# EasyEDA Pro project F4_Camera.eprj

# Schematic Schematic1
Board Name: Board1; Create Date: 2025-01-09
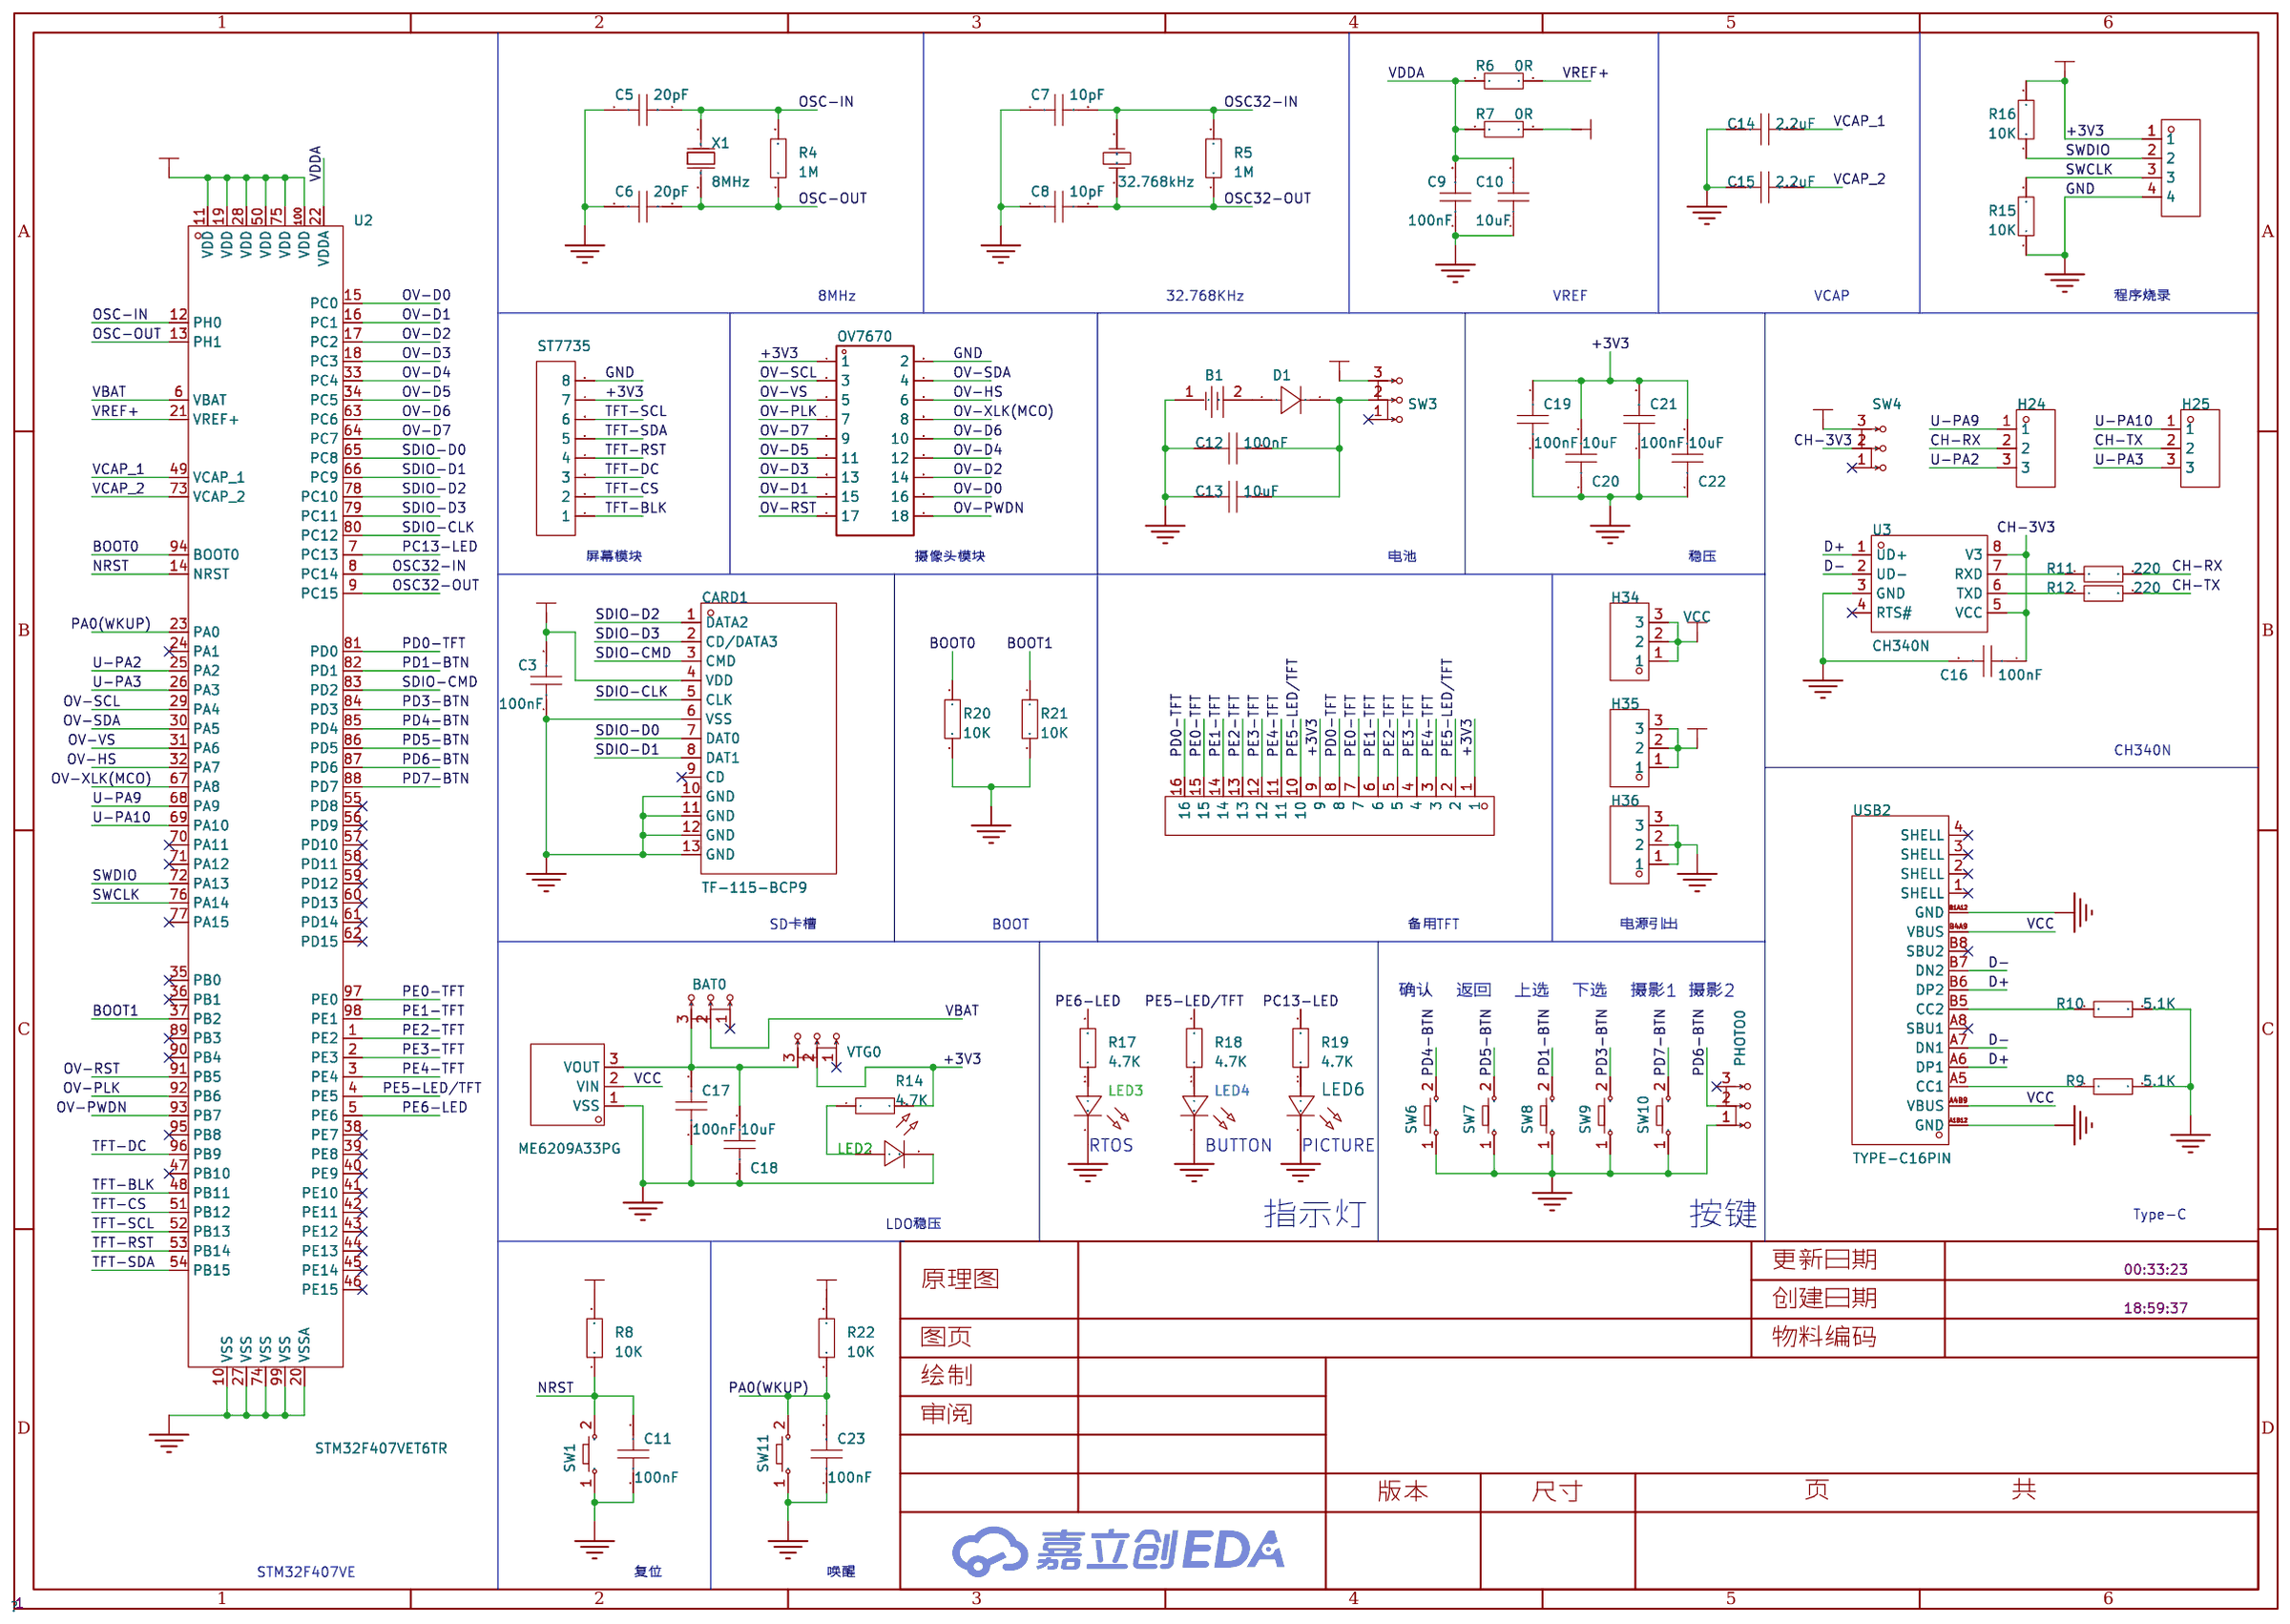
[diagram p0: schematic sheet]

## Parts
B1  BS-02-A1AJ010  [BAT-TH_BS-02-A1AJ010]
BAT0  SS-12D01-G5  [SW-TH_SS-12D01-GX]
C3  100nF  [C0805]
C5  20pF  [C0805]
C6  20pF  [C0805]
C7  10pF  [C0805]
C8  10pF  [C0805]
C9  100nF  [C0805]
C10  10uF  [C0805]
C11  100nF  [C0805]
C12  100nF  [C0805]
C13  10uF  [C0805]
C14  2.2uF  [C0805]
C15  2.2uF  [C0805]
C16  100nF  [C0805]
C17  100nF  [C0805]
C18  10uF  [C0805]
C19  100nF  [C0805]
C20  10uF  [C0805]
C21  100nF  [C0805]
C22  10uF  [C0805]
C23  100nF  [C0805]
CARD1  TF-115-BCP9  [TF-SMD_TF-115-BCP9]
D1  -  [SMA_1N4007]
H24  -  [HDR-TH_3P-P2.54-V-M]
H25  -  [HDR-TH_3P-P2.54-V-M]
H34  -  [HDR-TH_3P-P2.54-V-M]
H35  -  [HDR-TH_3P-P2.54-V-M]
H36  -  [HDR-TH_3P-P2.54-V-M]
H37  -  [HDR-TH_4P-P2.54-V-M]
H38  -  [HDR-TH_16P-P2.54-V-F]
LED2  -  [LED_0805]
LED3  -  [LED_0805]
LED4  -  [LED_0805]
LED6  -  [LED_0805]
OV7670  -  [HDR-TH_18P-P2.54-V-F-R2-C9-S2.54-1]
PHOTO0  SS-12D01-G5  [SW-TH_SS-12D01-GX]
R4  1M  [R0805]
R5  1M  [R0805]
R6  0R  [R0805]
R7  0R  [R0805]
R8  10K  [R0805]
R9  5.1K  [R0805]
R10  5.1K  [R0805]
R11  220  [R0805]
R12  220  [R0805]
R14  4.7K  [R0805]
R15  10K  [R0805]
R16  10K  [R0805]
R17  4.7K  [R0805]
R18  4.7K  [R0805]
R19  4.7K  [R0805]
R20  10K  [R0805]
R21  10K  [R0805]
R22  10K  [R0805]
ST7735  -  [HDR-TH_8P-P2.54-V-F-1]
SW1  -  [Key_SMD_3x4x2]
SW3  SS-12D01-G5  [SW-TH_SS-12D01-GX]
SW4  SS-12D01-G5  [SW-TH_SS-12D01-GX]
SW6  -  [Key_SMD_3x4x2]
SW7  -  [Key_SMD_3x4x2]
SW8  -  [Key_SMD_3x4x2]
SW9  -  [Key_SMD_3x4x2]
SW10  -  [Key_SMD_3x4x2]
SW11  -  [Key_SMD_3x4x2]
U2  STM32F407VET6TR  [LQFP-100_L14.0-W14.0-P0.50-LS16.0-BL]
U3  CH340N  [SOP-8_L4.9-W3.9-P1.27-LS6.0-BL]
U4  ME6209A33PG  [SOT-89-3_L4.5-W2.5-P1.50-LS4.2-BR]
USB2  TYPE-C16PIN  [USB-C-SMD_TYPE-C16PIN]
VTG0  SS-12D01-G5  [SW-TH_SS-12D01-GX]
X1  8MHz  [CRYSTAL-SMD_L11.5-W4.8-LS12.7]
X3  32.768kHz  [OSC-TH_BD3.1-P0.8-D0.3]

## Library data of the parts
B1 = BS-02-A1AJ010: LCSC Part Name: 电池底座 适用电池:CR2032; Supplier Part: C5239862; Manufacturer: MYOUNG(美阳); Supplier Footprint: 插件; JLCPCB Part Class: 扩展库; Datasheet: https://atta.szlcsc.com/upload/public/pdf/source/20221102/8F00F2B23A2A3C447A59C327BBA6C743.pdf; Supplier: LCSC; Connector Type: 电池底座; Battery Type: CR2032; Contact Material: 磷青铜; Contact Plating: 镍; Operating Temperature Range: -25℃~+85℃
BAT0 PHOTO0 SW3 SW4 VTG0 = SS-12D01-G5: LCSC Part Name: 8.8*3.9*4.0mm/柄长5MM,1P2T; Supplier Part: C698218; Manufacturer: USAKRO(美韩); Supplier Footprint: 插件; JLCPCB Part Class: 扩展库; Datasheet: https://atta.szlcsc.com/upload/public/pdf/source/20200708/C698218_847C5BF192AAD1D7BD79B672259211AF.pdf; Supplier: LCSC
C3 C9-C23 = CAP_0805: Supplier Footprint: 0805
C5-C8 = CAP_0603: Supplier Footprint: 0603; Check: true
CARD1 = TF-115-BCP9: 卡连接方式:自弹式;卡类型:MicroSD卡(TF卡);连接器类型:卡座;本体最大高度:1.8mm;工作温度范围:-25℃~+85℃;; LCSC Part Name: 自弹式 MicroSD卡(TF卡) 卡座; Supplier Part: C720505; Manufacturer: XUNPU(讯普); Supplier Footprint: SMD; JLCPCB Part Class: 扩展库; Datasheet: https://atta.szlcsc.com/upload/public/pdf/source/20210906/DBEC8F03AA1503572333C7CF4A76D0AD.pdf; Supplier: LCSC; Card Connection Mode: 自弹式; Card Type: MicroSD卡(TF卡); Connector Type: 卡座; Maximum Body Height: 1.8mm; Operating Temperature Range: -25℃~+85℃
D1 = D_1N4007: Supplier Footprint: SMA
H24 H25 H34-H36 = HDR-M_2.54_1x3P: Supplier Part: C2937625; Supplier Footprint: 插件
H37 = HDR-M_2.54_1x4P: Supplier Part: C492403; Supplier Footprint: 插件
H38 = HDR-F_2.54_1x16P: Supplier Part: C124409; Supplier Footprint: 插件
LED2 LED3 = LED_0805-G: Supplier Footprint: 0805
LED4 = LED_0805-B: Supplier Footprint: 0805
LED6 = LED_0805-R: Supplier Footprint: 0805
OV7670 = HDR-F_2.54_2x9: Supplier Part: C132125; Supplier Footprint: 插件
R4 R5 R15 R16 = Res_0603: Supplier Footprint: 0603; Check: true
R6-R12 R14 R17-R22 = Res_0805: Supplier Footprint: 0805
ST7735 = HDR-F_2.54_1x8P: Supplier Part: C27438; Supplier Footprint: 插件
SW1 SW6-SW11 = Key_SMD_3x4x2: Supplier Footprint: SMD
U2 = STM32F407VET6TR: LCSC Part Name: 带DSP和FPU的高性能基础系列ARM Cortex-M4 MCU，具有512 KB Flash、168 MHz CPU、ART加速器、以太网和FSMC; Supplier Part: C5269943; Manufacturer: ST(意法半导体); Supplier Footprint: LQFP-100(14x14); JLCPCB Part Class: 扩展库; Datasheet: https://atta.szlcsc.com/upload/public/pdf/source/20201130/C919362_39400D478C258148B3DF984CE4A4041A.pdf; Supplier: LCSC; CPU Core: ARM-M4; CPU Maximum Speed: 168MHz; Number of I/O: 82; ADC (Bit): 12bit; DAC (Bit): 12bit; Low Voltage Detection Threshold: 1.8V~3.6V
U3 = CH340N: LCSC Part Name: USB转串口芯片CH340; Supplier Part: C2977777; Manufacturer: WCH(南京沁恒); Supplier Footprint: SOP-8; JLCPCB Part Class: 扩展库; Datasheet: https://atta.szlcsc.com/upload/public/pdf/source/20240313/115CDE92081B1D6CB446704AD5D0F5F2.pdf; Supplier: LCSC; Applications Function: USB转串口; Protocol: USB 2.0; Number of Channels: 1; Supply Voltage: 3.3V；5V; Data Rate: 2Mbps; Operating Temperature: -20℃~+70℃
U4 = ME6209A33PG: LCSC Part Name: 输入18V 输出3.3V 250mA; Supplier Part: C80222; Manufacturer: MICRONE(南京微盟); Supplier Footprint: SOT-89-3; JLCPCB Part Class: 扩展库; Datasheet: https://atta.szlcsc.com/upload/public/pdf/source/20160903/1472896599532.pdf; Supplier: LCSC; Output Type: 固定; Maximum Input Voltage: 18V; Output Voltage: 3.3V; MAX Output Current: 250mA; Dropout Voltage: 80mV@(40mA); Output Polarity: 正极; Number of Outputs: 1
USB2 = TYPE-C16PIN: 连接器类型:Type-C;标准:USB 3.1;公母:母;安装方式:卧贴;触点数量:16P;端口数量:1;额定电流 - 电源:3A;工作温度范围:-40℃~+85℃;; LCSC Part Name: Type-C 母 卧贴; Supplier Part: C393939; Manufacturer: SHOU HAN(首韩); Supplier Footprint: SMD; JLCPCB Part Class: 扩展库; Datasheet: https://atta.szlcsc.com/upload/public/pdf/source/20190521/C393939_7B9043D4CF1026AF443AB60D91FBCD5C.pdf; Supplier: LCSC; Connector Type: Type-C; Standard: USB 3.1; Gender: 母; Mounting Style: 卧贴; Number of Contacts: 16P; Number of Ports: 1; Current Rating - Power (Max): 3A; Operating Temperature Range: -40℃~+85℃; Rated Voltage (Max): 30V; Connect-Disconnect Life: 1万次; Core Colour: 黑色; Check: true
X1 = X49SM8MSD2SC: 晶振类型:贴片晶振;频率:8MHz;常温频差:±20ppm;外接负载电容:20pF;频率稳定度(全温):±30ppm;; LCSC Part Name: 8MHz ±20ppm 20pF; Supplier Part: C12674; Manufacturer: YXC(扬兴晶振); Supplier Footprint: HC-49S-SMD; JLCPCB Part Class: 基础库; Datasheet: https://atta.szlcsc.com/upload/public/pdf/source/20240329/3EBF42EBCAB50CA65B6FA9D7CFA1955A.pdf; Supplier: LCSC; Crystal Type: 贴片晶振; Normal temperature Frequency Tolerance: ±20ppm; External load capacitor: 20pF; Frequency Stability(Full temperature range): ±30ppm; Operating Temperature: -20℃~+70℃; Check: true
X3 = X308032768KGB2SC: 晶振类型:直插晶振;频率:32.768kHz;常温频差:±10ppm;外接负载电容:12.5pF;频率稳定度(全温):-;; LCSC Part Name: 32.768kHz ±10ppm 12.5pF YT-38; Supplier Part: C52082; Manufacturer: YXC(扬兴晶振); Supplier Footprint: DT-38; JLCPCB Part Class: 扩展库; Datasheet: https://atta.szlcsc.com/upload/public/pdf/source/20240329/231E1A1EB7C875CD193DBE6664A3DE3A.pdf; Supplier: LCSC; Crystal Type: 直插晶振; Normal temperature Frequency Tolerance: ±10ppm; External load capacitor: 12.5pF; Operating Temperature: -20℃~+70℃

## Nets
+3V3: C3.2 C19.2 C20.2 C21.2 C22.2 CARD1.4(VDD) H35.1 H35.2 H35.3 H37.1 H38.1 H38.9 OV7670.1 R7.2 R8.2 R14.2 R16.2 R22.2 ST7735.7 SW4.3 U2.11(VDD) U2.19(VDD) U2.28(VDD) U2.50(VDD) U2.75(VDD) U2.100(VDD) VTG0.2
GND: B1.1 C3.1 C5.1 C6.1 C7.1 C8.1 C9.1 C10.1 C11.1 C12.1 C13.1 C14.2 C15.2 C16.2 C17.1 C18.1 C19.1 C20.1 C21.1 C22.1 C23.1 CARD1.6(VSS) CARD1.10(GND) CARD1.11(GND) CARD1.12(GND) CARD1.13(GND) H36.1 H36.2 H36.3 H37.4 LED2.1(C) LED3.1(C) LED4.1(C) LED6.1(C) OV7670.2 PHOTO0.1 R9.2 R10.2 R15.1 R20.2 R21.2 ST7735.8 SW1.1 SW6.1 SW7.1 SW8.1 SW9.1 SW10.1 SW11.1 U2.10(VSS) U2.20(VSSA) U2.27(VSS) U2.74(VSS) U2.99(VSS) U3.3(GND) U4.1(VSS) USB2.A1B12(GND) USB2.B1A12(GND)
VBAT: BAT0.2 U2.6(VBAT)
VCC: H34.1 H34.2 H34.3 SW3.3 U4.2(VIN) USB2.A4B9(VBUS) USB2.B4A9(VBUS)
VDDA: C9.2 C10.2 R6.1 R7.1 U2.22(VDDA)
BOOT0: R20.1 U2.94(BOOT0)
BOOT1: R21.1 U2.37(PB2)
CH-3V3: C16.1 SW4.2 U3.5(VCC) U3.8(V3)
CH-RX: H24.2 R11.2
CH-TX: H25.2 R12.2
D+: U3.1(UD+) USB2.A6(DP1) USB2.B6(DP2)
D-: U3.2(UD-) USB2.A7(DN1) USB2.B7(DN2)
NRST: C11.2 R8.1 SW1.2 U2.14(NRST)
OSC32-IN: C7.2 R5.2 U2.8(PC14) X3.1(OSC1)
OSC32-OUT: C8.2 R5.1 U2.9(PC15) X3.2(OSC2)
OSC-IN: C5.2 R4.2 U2.12(PH0) X1.1(OSC1)
OSC-OUT: C6.2 R4.1 U2.13(PH1) X1.2(OSC2)
OV-D0: OV7670.16 U2.15(PC0)
OV-D1: OV7670.15 U2.16(PC1)
OV-D2: OV7670.14 U2.17(PC2)
OV-D3: OV7670.13 U2.18(PC3)
OV-D4: OV7670.12 U2.33(PC4)
OV-D5: OV7670.11 U2.34(PC5)
OV-D6: OV7670.10 U2.63(PC6)
OV-D7: OV7670.9 U2.64(PC7)
OV-HS: OV7670.6 U2.32(PA7)
OV-PLK: OV7670.7 U2.92(PB6)
OV-PWDN: OV7670.18 U2.93(PB7)
OV-RST: OV7670.17 U2.91(PB5)
OV-SCL: OV7670.3 U2.29(PA4)
OV-SDA: OV7670.4 U2.30(PA5)
OV-VS: OV7670.5 U2.31(PA6)
OV-XLK(MCO): OV7670.8 U2.67(PA8)
PA0(WKUP): C23.2 R22.1 SW11.2 U2.23(PA0)
PC13-LED: R19.2 U2.7(PC13)
PD0-TFT: H38.8 H38.16 U2.81(PD0)
PD1-BTN: SW8.2 U2.82(PD1)
PD3-BTN: SW9.2 U2.84(PD3)
PD4-BTN: SW6.2 U2.85(PD4)
PD5-BTN: SW7.2 U2.86(PD5)
PD6-BTN: PHOTO0.2 U2.87(PD6)
PD7-BTN: SW10.2 U2.88(PD7)
PE0-TFT: H38.7 H38.15 U2.97(PE0)
PE1-TFT: H38.6 H38.14 U2.98(PE1)
PE2-TFT: H38.5 H38.13 U2.1(PE2)
PE3-TFT: H38.4 H38.12 U2.2(PE3)
PE4-TFT: H38.3 H38.11 U2.3(PE4)
PE5-LED/TFT: H38.2 H38.10 R18.2 U2.4(PE5)
PE6-LED: R17.2 U2.5(PE6)
SDIO-CLK: CARD1.5(CLK) U2.80(PC12)
SDIO-CMD: CARD1.3(CMD) U2.83(PD2)
SDIO-D0: CARD1.7(DAT0) U2.65(PC8)
SDIO-D1: CARD1.8(DAT1) U2.66(PC9)
SDIO-D2: CARD1.1(DATA2) U2.78(PC10)
SDIO-D3: CARD1.2(CD/DATA3) U2.79(PC11)
SWCLK: H37.3 R15.2 U2.76(PA14)
SWDIO: H37.2 R16.1 U2.72(PA13)
TFT-BLK: ST7735.1 U2.48(PB11)
TFT-CS: ST7735.2 U2.51(PB12)
TFT-DC: ST7735.3 U2.96(PB9)
TFT-RST: ST7735.4 U2.53(PB14)
TFT-SCL: ST7735.6 U2.52(PB13)
TFT-SDA: ST7735.5 U2.54(PB15)
U-PA2: H24.3 U2.25(PA2)
U-PA3: H25.3 U2.26(PA3)
U-PA9: H24.1 U2.68(PA9)
U-PA10: H25.1 U2.69(PA10)
VCAP_1: C14.1 U2.49(VCAP_1)
VCAP_2: C15.1 U2.73(VCAP_2)
VREF+: R6.2 U2.21(VREF+)
$1N4149: B1.2 D1.2(A)
$1N4157: C12.2 C13.2 D1.1(K) SW3.2
$1N4377: R9.1 USB2.A5(CC1)
$1N4405: R10.1 USB2.B5(CC2)
$1N4661: R11.1 U3.7(RXD)
$1N4738: R12.1 U3.6(TXD)
$1N5807: LED2.2(A) R14.1
$1N5874: BAT0.3 C17.2 C18.2 U4.3(VOUT) VTG0.3
$1N6809: LED3.2(A) R17.1
$1N6943: LED4.2(A) R18.1
$1N7074: LED6.2(A) R19.1

Not connected (* = marked no-connect by the designer): BAT0 1*; CARD1 9(CD)*; PHOTO0 3*; SW3 1*; SW4 1*; U2 24(PA1)* 35(PB0)* 36(PB1)* 38(PE7)* 39(PE8)* 40(PE9)* 41(PE10)* 42(PE11)* 43(PE12)* 44(PE13)* 45(PE14)* 46(PE15)* 47(PB10)* 55(PD8)* 56(PD9)* 57(PD10)* 58(PD11)* 59(PD12)* 60(PD13)* 61(PD14)* 62(PD15)* 70(PA11)* 71(PA12)* 77(PA15)* 89(PB3)* 90(PB4)* 95(PB8)*; U3 4(RTS#)*; USB2 1(SHELL)* 2(SHELL)* 3(SHELL)* 4(SHELL)* A8(SBU1)* B8(SBU2)*; VTG0 1*

## Notes on the sheet
- 8MHz
- 32.768KHz
- VREF
- VCAP
- 程序烧录
- 屏幕模块
- 摄像头模块
- 电池
- 稳压
- CH340N
- SD卡槽
- BOOT
- 备用TFT
- 电源引出
- 确认
- 返回
- 上选
- 下选
- 摄影1
- 摄影2
- RTOS
- BUTTON
- PICTURE
- LDO稳压
- 指示灯
- 按键
- Type-C
- STM32F407VE
- 复位
- 唤醒

# Board PCB1
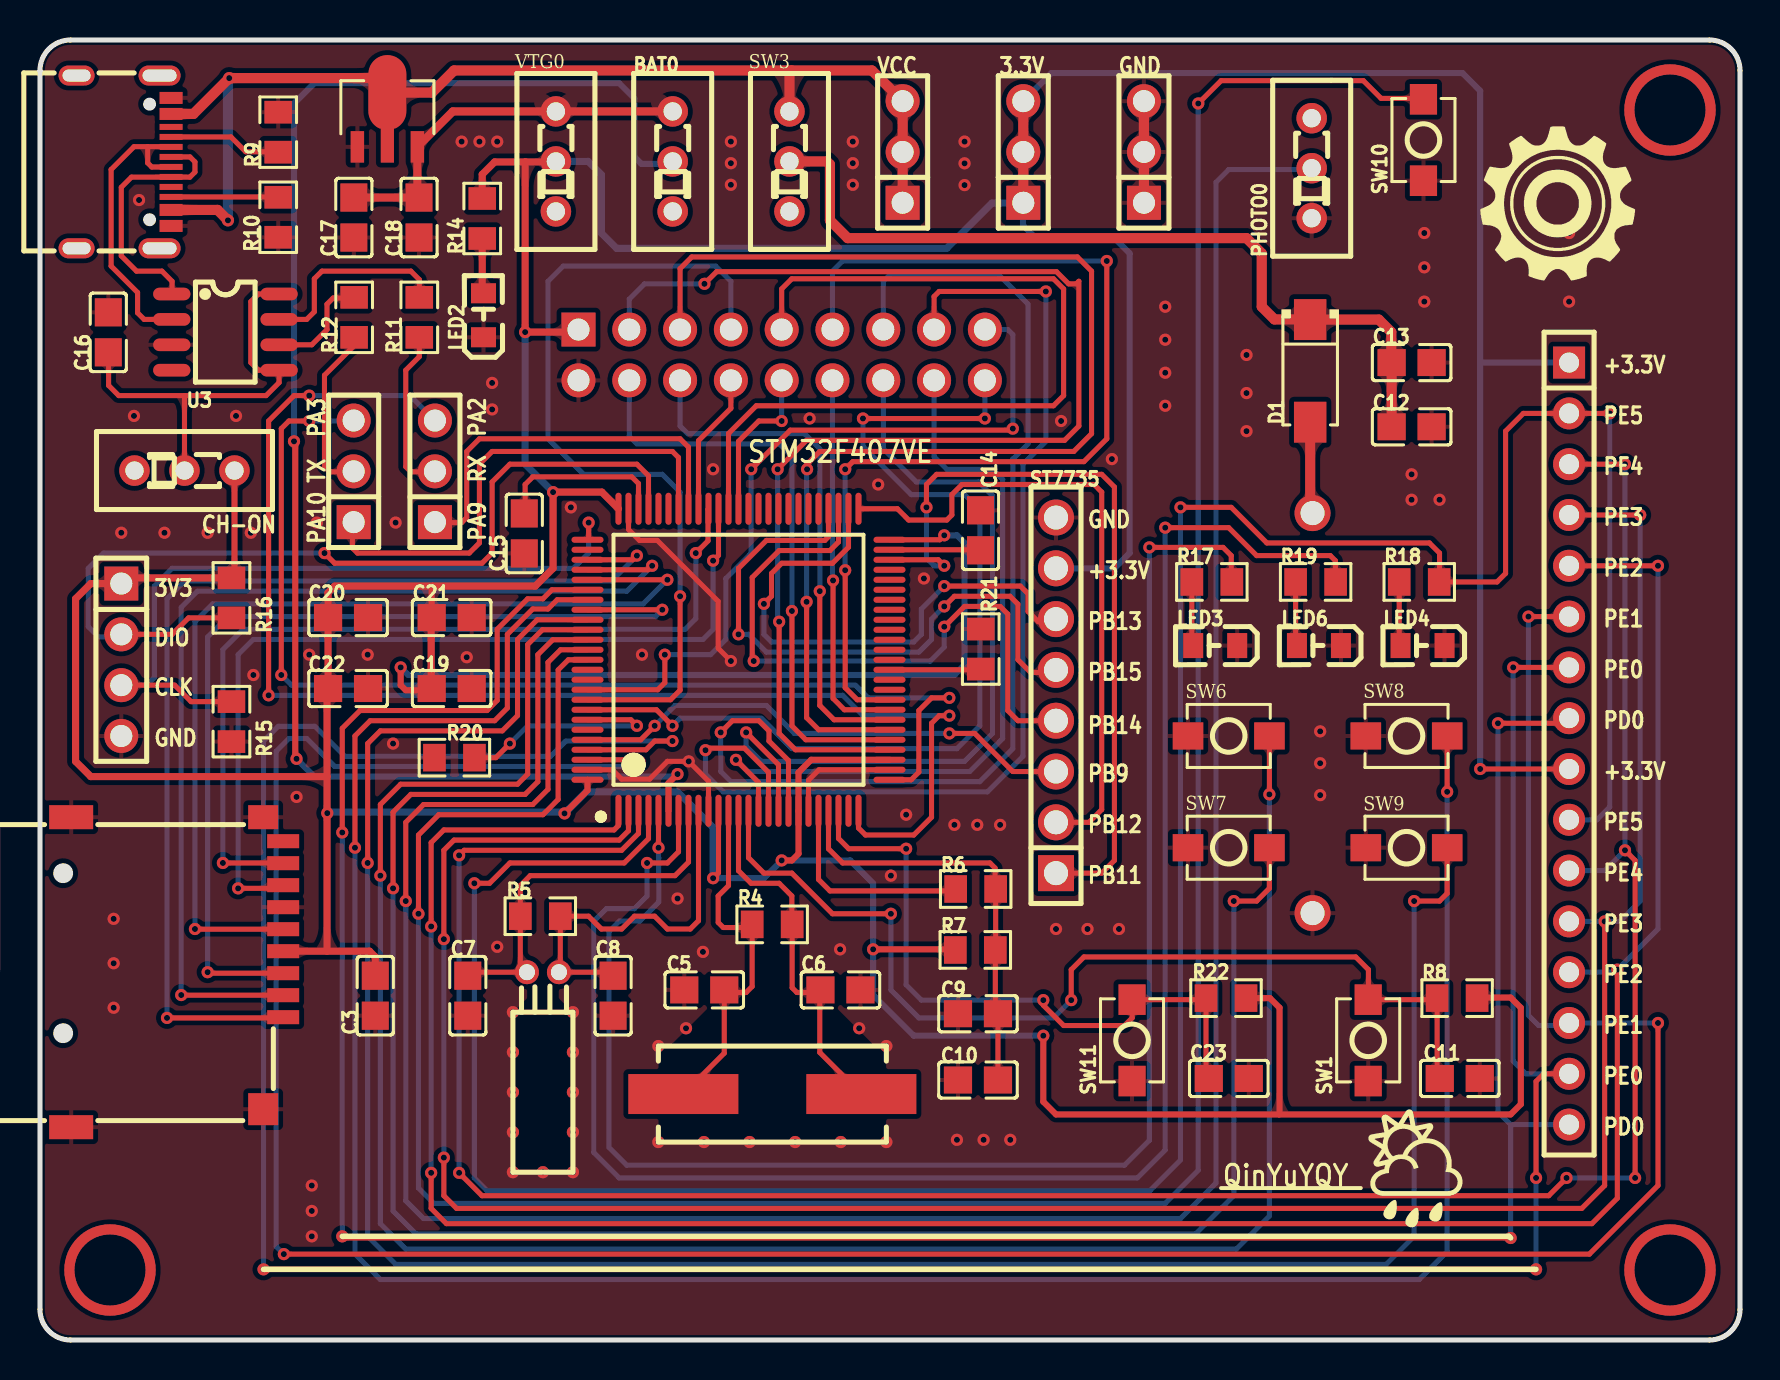
[diagram p1: board, top side]
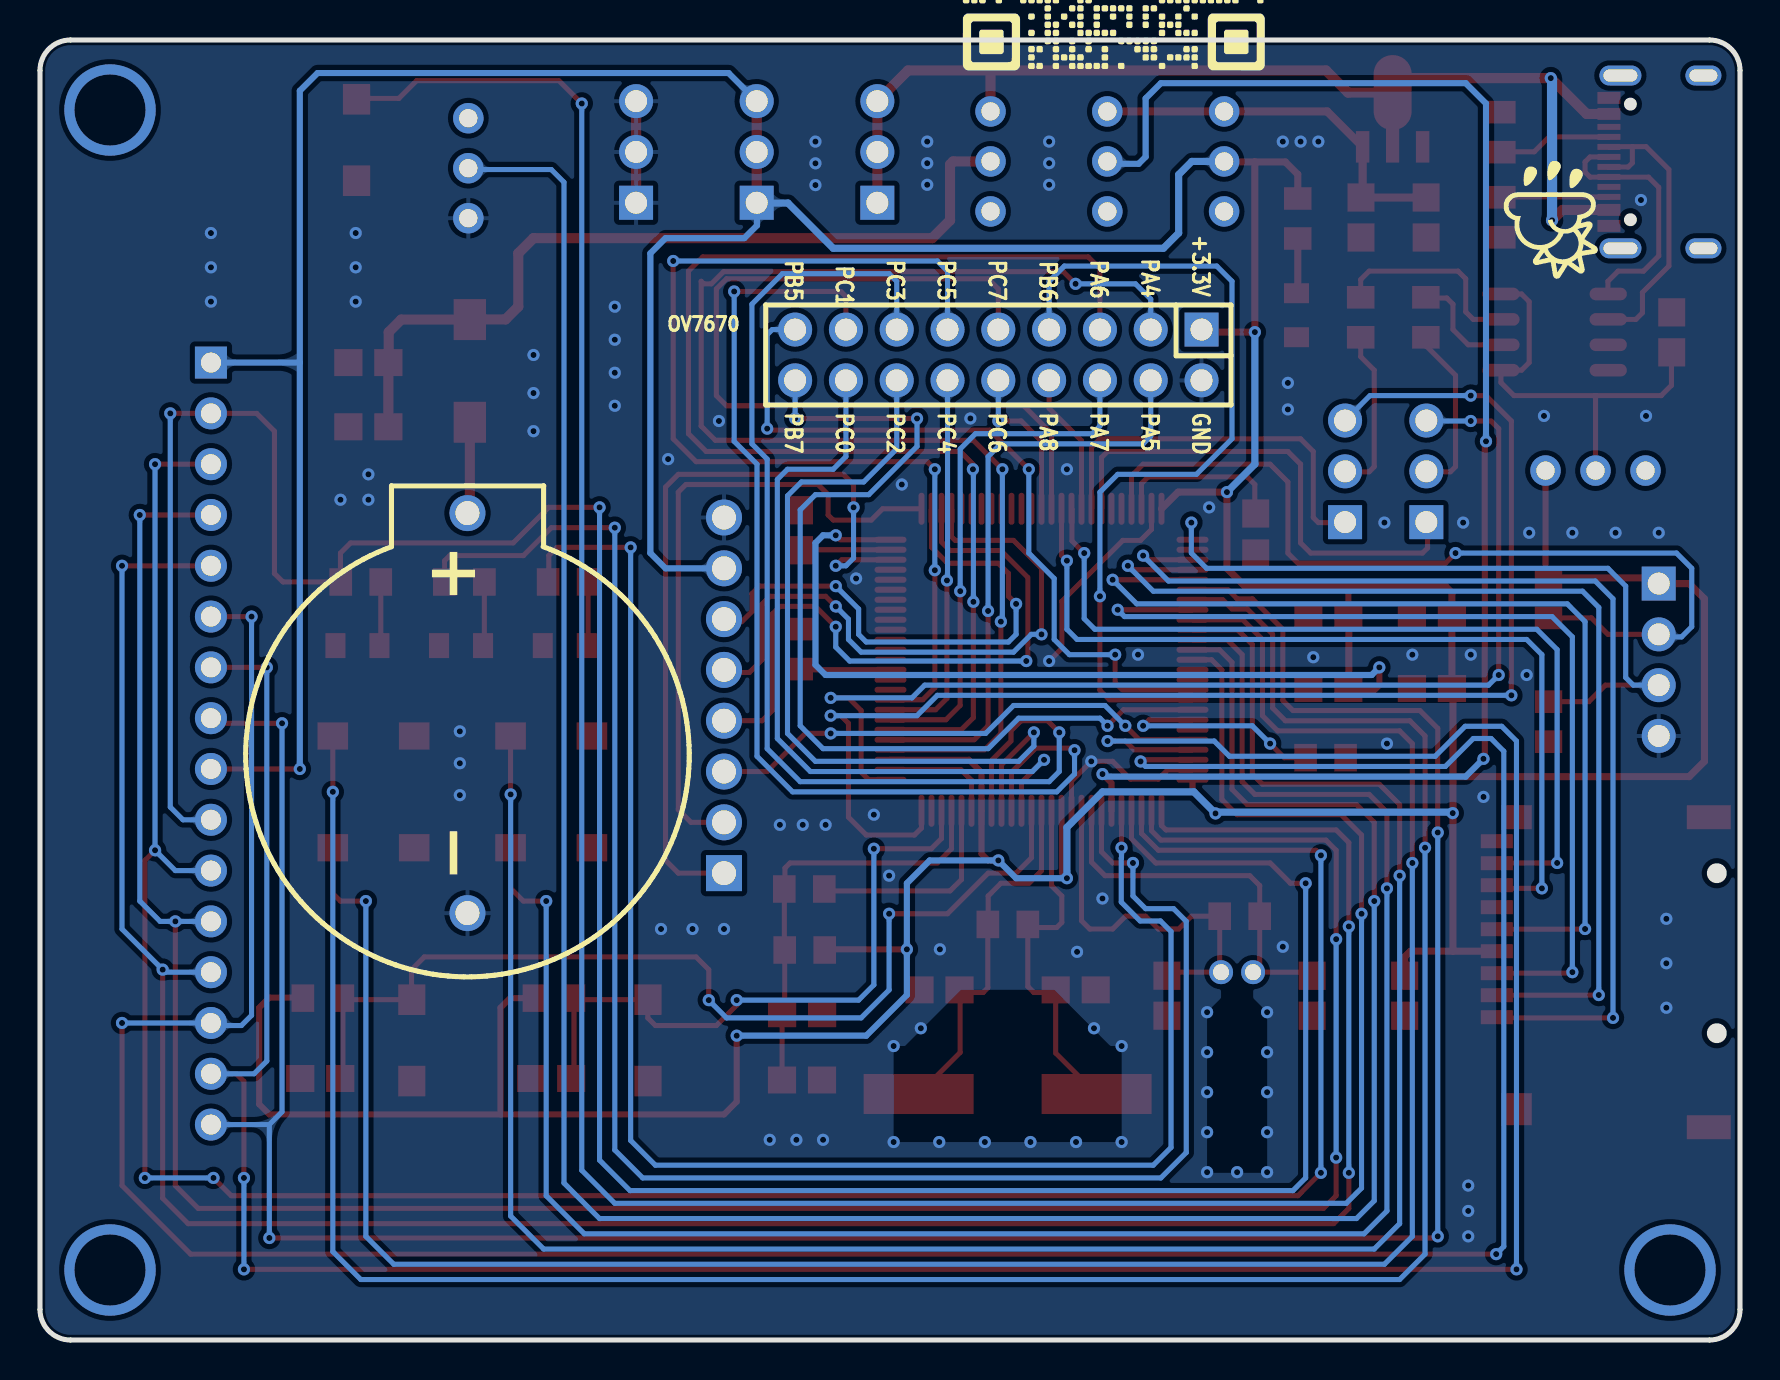
[diagram p2: board, bottom side, seen from below]

Outline 85 x 65 mm; copper layers: Top Layer, Bottom Layer. Coordinates in mm from the lower left corner of the outline.
Outline path: 0,63.48 0,1.52 arc(0.45,0.45) 1.52,0 83.48,0 arc(84.55,0.45) 85,1.52 85,63.48 arc(84.55,64.55) 83.48,65 1.52,65 arc(0.45,64.55) 0,63.48
Stack: Top Layer 0.035mm / Dielectric1 1.51mm FR4 er 4.5 / Bottom Layer 0.035mm

## Design rules (mm)
net OSC-OUT: DP1
net OSC-IN: DP1
net OSC32-OUT: DP2
net OSC32-IN: DP2
template: 自定义配置
spacing copperThickness1oz (default): track to track 0.102, other pairs 0.076 to 0.3
spacing copperThickness2oz: track to track 0.203, other pairs 0.152 to 0.3
track width copperThickness1oz (default): min 0.127, default 0.254, max 2.54
track width copperThickness2oz: min 0.203, default 0.254, max 2.54
differential pair differentialPair (default): width min 0.127, default 0.254, max 2.54; gap min 0.152, default 0.152
via viaSize (default): diameter min 0.5, default 0.61, max 10; hole min 0.3, default 0.305, max 6.299
